# EasyEDA Pro project MyWordEdit.eprj, board PCB1 (continued)
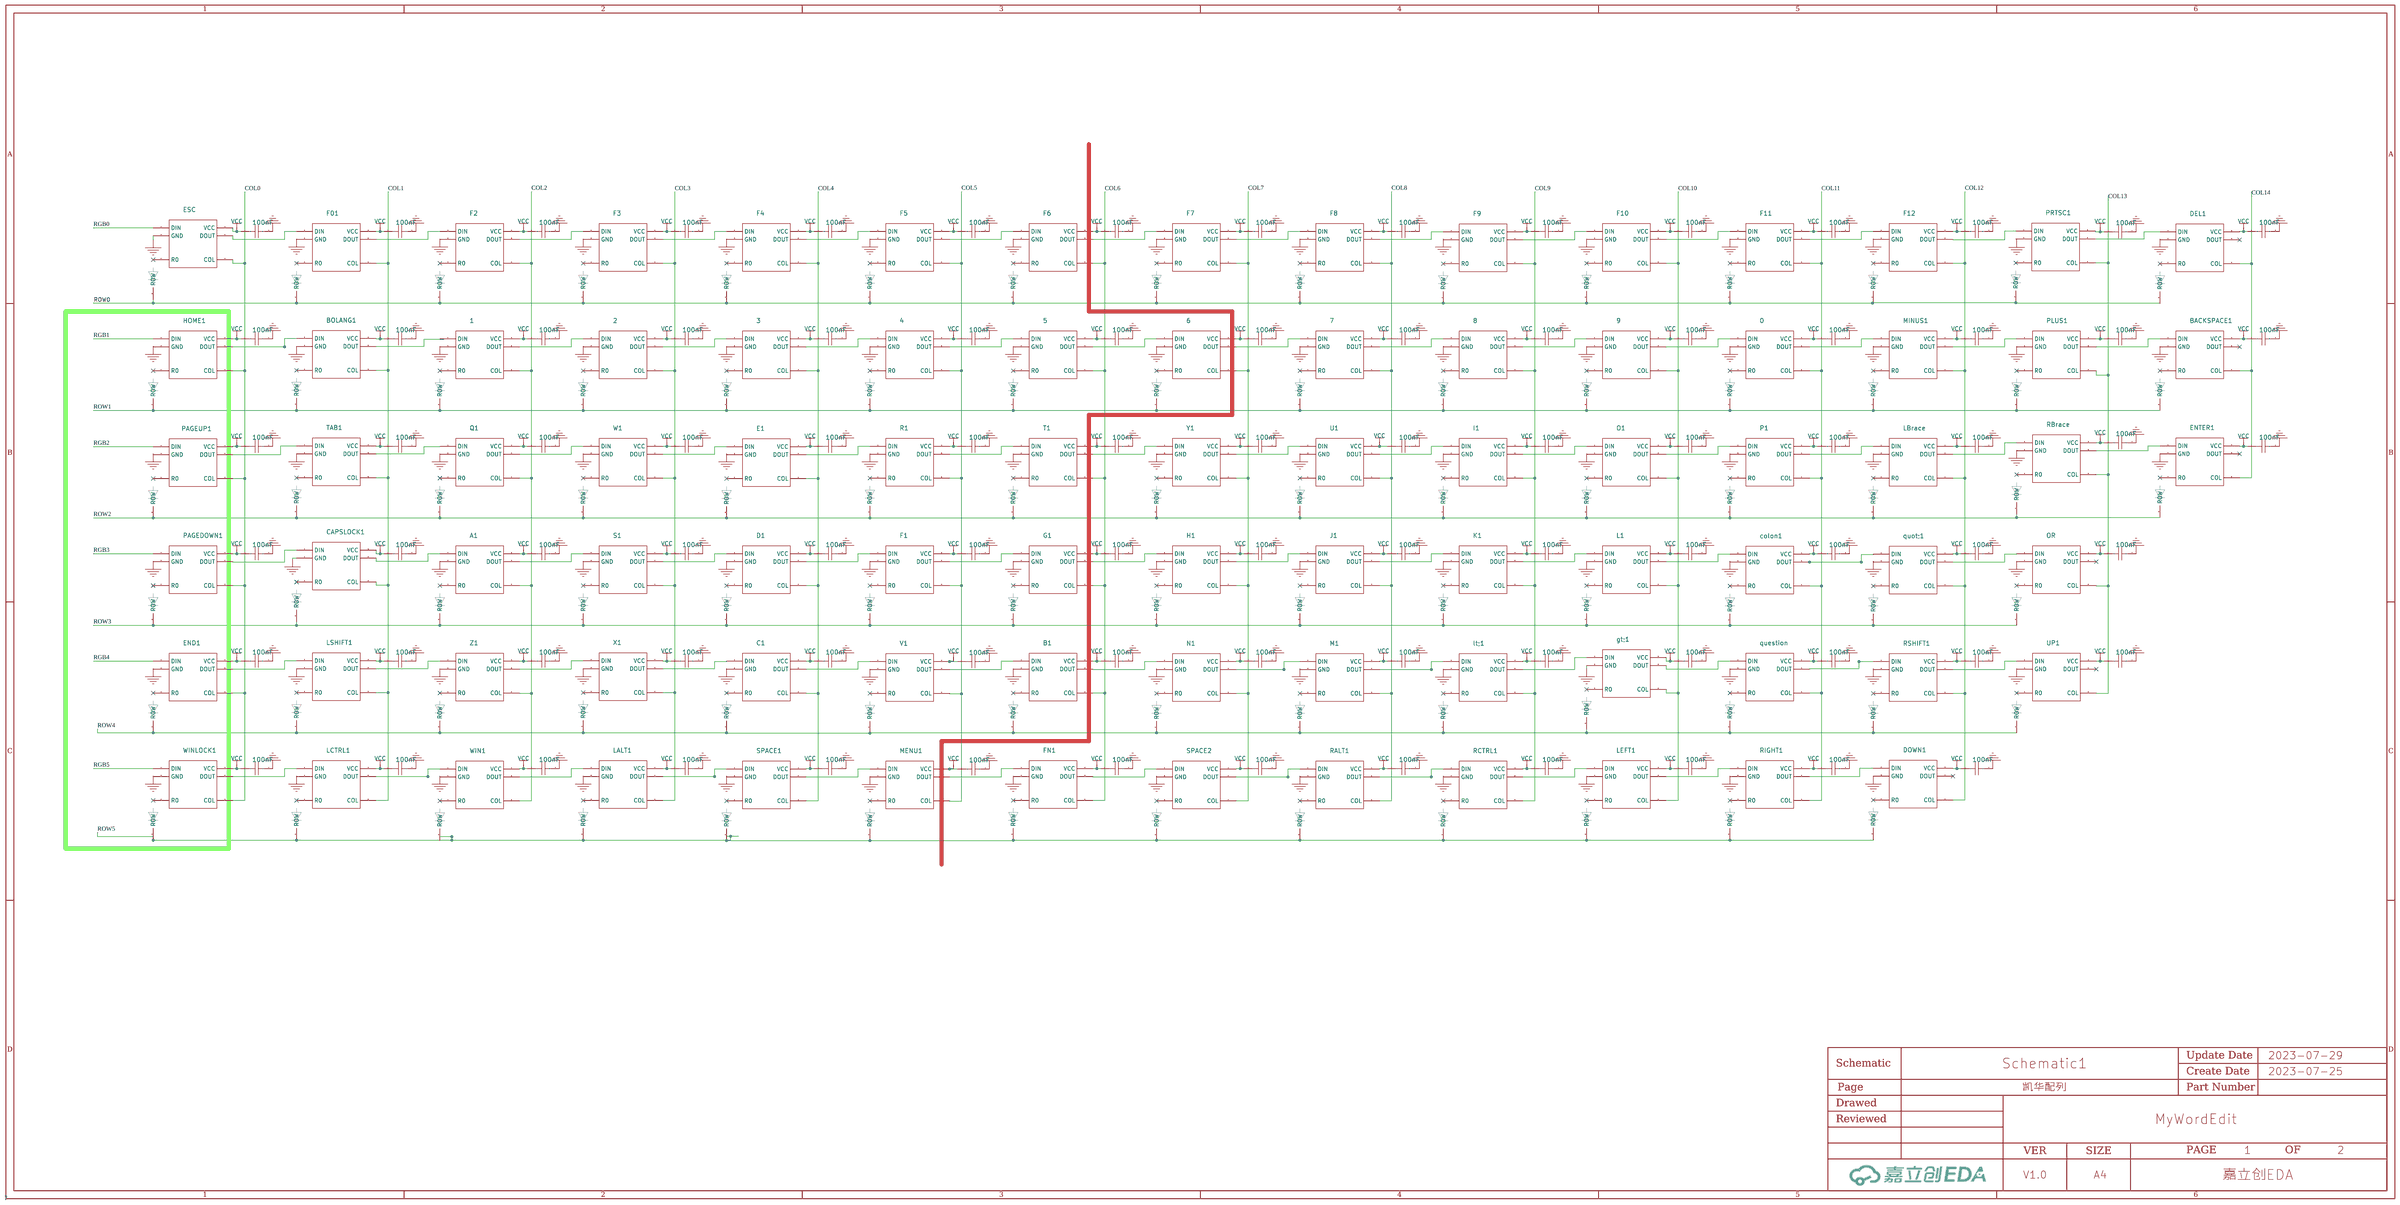
[diagram p0: 凯华配列]
## Routing (per net, layer and track width the routed paths; a pad name or vN(x,y) marks a point on that pad's centre or on a via; arc(x,y) is an arc through that point) (continued)
(no net): length 326.4
  Bottom Layer w0.254: L1.R0 233.64,49.63 L1.R0 ; 107.62,10.99 111.06,10.99 SPACE1.R0 ; colon1.R0 249.51,51.58 colon1.R0 ; 290.72,112.29 290.41,111.98 286.92,111.98 ; F2.R0 74.35,109.8 F2.R0 ; V1.R0 129.34,28.52 125.91,28.52 ; 134.04,65.98 134.39,65.62 T1.R0 ; BACKSPACE1.R0 301.46,93.82 BACKSPACE1.R0 ; F6.R0 150.17,103.19 146.74,103.19 ; ENTER1.R0 311.11,66.01 ENTER1.R0 ; F10.R0 233.39,107.03 F10.R0 ; H1.R0 176.74,44.67 H1.R0 ; OR.R0 290.66,54.58 OR.R0 ; END1.R0 11.61,48.33 11.97,47.97 ; F5.R0 131.25,104.84 F5.R0 ; 242.72,69.82 243.03,70.13 246.52,70.13 ; TAB1.R0 37.78,74.74 TAB1.R0 ; 5.R0 129.6,85.79 5.R0 ; 13.13,105.22 16.57,105.22 HOME1.R0 ; BOLANG1.R0 34.73,94.18 BOLANG1.R0 ; D1.R0 102.55,49.98 102.9,49.62 ; 260.25,33.12 263.74,33.12 question.R0 ; Y1.R0 167.21,63.52 Y1.R0 ; F7.R0 176.49,102.08 F7.R0 ; 1.R0 50.57,92.17 50.22,92.52 ; F01.R0 52.22,111.09 55.66,111.09 ; Q1.R0 58.45,72.36 Q1.R0 ; LALT1.R0 77.91,13.78 LALT1.R0 ; PLUS1.R0 269.83,91.72 PLUS1.R0 ; W1.R0 80.45,71.06 W1.R0 ; 268.12,52.93 268.43,53.23 271.92,53.23 ; RALT1.R0 241.77,12.16 RALT1.R0 ; 290.21,35.71 289.9,35.4 286.41,35.4 ; PAGEDOWN1.R0 13.27,67.25 PAGEDOWN1.R0 ; 2.R0 72.7,90.75 2.R0 ; F4.R0 112.33,106.49 F4.R0 ; 185.83,64.87 186.13,65.17 189.62,65.17 ; 191.92,103.73 195.41,103.73 195.72,104.03 ; 184.43,26.51 184.74,26.82 N1.R0 ; 8.R0 194.01,84.98 8.R0 ; DOWN1.R0 314.4,19.07 DOWN1.R0 ; 226.2,30.12 222.71,30.12 222.4,29.81 ; RCTRL1.R0 260.69,13.81 257.2,13.81 ; 89.84,108.15 93.28,108.15 F3.R0 ; CAPSLOCK1.R0 38.54,55.57 38.9,55.21 ; F1.R0 121.47,48.33 F1.R0 ; WINLOCK1.R0 6.88,29.05 6.53,29.41 ; 178.45,83.33 174.96,83.33 174.65,83.03 ; ESC.R0 36.38,113.1 32.94,113.1 ; F9.R0 211.28,105.69 F9.R0 ; PAGEUP1.R0 14.92,86.3 PAGEUP1.R0 ; 41.94,35.78 41.59,36.14 LSHIFT1.R0 ; LCTRL1.R0 30.41,17.98 30.77,17.62 ; 80.19,51.63 83.62,51.63 S1.R0 ; X1.R0 91.37,31.82 91.73,31.46 ; LBrace.R0 265.26,71.6 LBrace.R0 ; 137.08,46.68 140.52,46.68 G1.R0 ; C1.R0 110.42,30.17 C1.R0 ; UP1.R0 315.94,37.69 312.44,37.69 ; Z1.R0 72.45,33.47 69.01,33.47 ; F11.R0 249.25,108.99 F11.R0 ; FN1.R0 180.05,6.7 176.55,6.7 ; gt;1.R0 241.63,31.77 gt;1.R0 ; M1.R0 206.84,28.16 M1.R0 ; A1.R0 64.57,53.28 A1.R0 ; 192.18,46.32 192.48,46.63 J1.R0 ; 215.02,48.28 211.53,48.28 211.23,47.97 ; MINUS1.R0 250.9,89.94 MINUS1.R0 ; 231.55,87.98 235.04,87.98 235.34,88.29 ; SPACE2.R0 210.91,9.37 SPACE2.R0 ; 3.R0 91.62,89.1 3.R0 ; WIN1.R0 54.16,15.94 50.72,15.94 ; 148.88,83.79 148.52,84.14 6.R0 ; RBrace.R0 284.19,73.25 280.69,73.25 ; 223.8,68.17 227.29,68.17 O1.R0 ; 267.87,110.33 271.36,110.33 F12.R0 ; MENU1.R0 141.92,8.2 MENU1.R0 ; RIGHT1.R0 298.66,17.11 RIGHT1.R0 ; B1.R0 148.27,26.87 B1.R0 ; 9.R0 212.93,86.64 9.R0 ; R1.R0 118.42,67.63 R1.R0 ; 107.11,87.44 110.55,87.44 4.R0 ; DEL1.R0 309.33,113.63 DEL1.R0
AT: length 102.6
  Top Layer w0.254: v1(151.64,56.26) 152.22,55.68 154.07,55.68 156.5,53.24 159.04,53.24 161.54,50.74 v1(161.54,48.51) ; v1(153.67,68.2) 153.67,60.71 151.77,58.8 v1(151.77,57.78) ; v1(162.94,47.12) 162.94,44.7 v1(163.07,44.58) ; v1(163.83,89.79) 163.83,83.31 158.12,77.6 156.15,77.6 153.8,75.25 153.8,71.37 v1(153.67,71.25) ; v1(163.83,92.71) 163.83,103.89 159.34,108.37 v1(159.34,119.13)
  Bottom Layer w0.254: v1(161.54,48.51) v1(162.94,47.12) ; v1(153.67,71.25) v1(153.67,68.2) ; v1(151.77,57.78) 151.64,57.66 v1(151.64,56.26) ; v1(159.34,119.13) BTK-05.26 ; v1(163.07,44.58) 163.07,44.18 162.96,44.07 U6.22 ; v1(163.83,92.71) v1(163.83,89.79)
BOOT0: length 50.2
  Top Layer w0.254: v1(160.02,47.24) 160.02,47.24 160.91,46.35 160.91,38.04 162.56,36.38 162.56,33.91 162.89,33.58 162.89,31.32 162.31,30.73 v1(162.31,18.29) ; v1(162.31,12.32) v1(162.31,16.26)
  Bottom Layer w0.254: v1(162.31,16.26) v1(162.31,18.29) ; U6.60 163.53,54.52 163.53,52.91 162.81,52.2 160.53,52.2 158.32,49.99 158.32,48.95 v1(160.02,47.24) ; R4.1 163.45,11.18 v1(162.31,12.32)
BOOT1: length 32
  Top Layer w0.254: v1(160.78,36.83) 160.77,36.83 159.51,38.08 v1(159.51,41.27) ; v1(161.42,18.41) 161.67,18.67 v1(161.67,20.45) ; v1(161.16,35.18) v1(161.16,32.13)
  Bottom Layer w0.254: v1(160.78,36.83) 161.16,36.45 v1(161.16,35.18) ; v1(161.16,32.13) 161.95,31.34 161.95,20.73 v1(161.67,20.45) ; v1(161.42,18.41) 161.72,18.11 161.72,14.55 162.18,14.1 R3.2 ; v1(159.51,41.27) 159.96,41.72 U6.28
COL0: length 277.3
  Top Layer w0.254: v1(24.13,36.19) 24.13,33.53 v1(23.75,33.15) ; v1(36.83,109.85) 35.94,108.97 v1(34.42,108.97) ; v1(28.7,93.47) 27.44,92.21 v1(27.44,90.81) ; v1(25.91,75.56) v1(25.91,72.83) ; v1(25.78,55.88) 25.78,52.7 v1(25.53,52.45) ; v1(27.05,67.31) 29.46,64.9 29.46,57.28 33.78,52.96 52.71,52.96 55.25,50.42 72.01,50.42 73.53,48.89 89.15,48.89 90.68,47.37 105.67,47.37 107.06,45.97 126.02,45.97 127.97,44.02 154.89,44.02 v1(155.07,44.2)
  Bottom Layer w0.254: U6.33 155.07,44.2 v1(155.07,44.2) ; 23.51,106.69 23.64,106.56 HOME1.COL ; PAGEUP1.COL 22.14,87.48 25.52,87.48 ; PAGEDOWN1.COL 25.78,66.52 v1(25.78,55.88) ; PAGEDOWN1.COL 25.91,70.78 v1(25.91,72.83) ; PAGEDOWN1.COL 25.77,68.59 v1(27.05,67.31) ; PAGEDOWN1.COL 23.59,68.71 PAGEDOWN1.COL ; HOME1.COL 28.7,104.87 v1(28.7,93.47) ; HOME1.COL 29.42,108.97 v1(34.42,108.97) ; WINLOCK1.COL 20.28,30.87 WINLOCK1.COL 21.34,30.74 v1(23.75,33.15) ; v1(25.91,75.56) 25.91,87.09 25.52,87.48 ; 18.56,49.79 19.05,49.3 22.43,49.3 ; v1(27.44,90.81) 27.44,89.71 PAGEUP1.COL 25.52,87.48 ; 22.43,49.3 24.13,47.6 v1(24.13,36.19) ; 22.43,49.3 22.06,49.66 22.74,49.66 v1(25.53,52.45) ; v1(36.83,109.85) 42.25,109.85 ESC.COL 43.45,114.43 ESC.COL
COL1: length 263.6
  Top Layer w0.254: v1(154.43,44.96) 153.85,44.37 145.52,44.37 141.5,48.39 140.25,48.39 136.24,44.37 128.12,44.37 122.62,49.88 121.04,49.88 117.49,46.33 108.89,46.33 103.69,51.53 102.11,51.53 98.31,47.73 90.83,47.73 85.37,53.18 83.19,53.18 81.96,51.94 69.72,51.94 65.66,56.01 53.34,56.01 v1(52.71,55.37) ; v1(54.86,43.94) v1(54.86,42.13) ; v1(48.9,104.39) 48.9,104.3 v1(47.63,103.03) ; v1(49.91,82.8) v1(49.91,80.38) ; v1(51.56,63.75) v1(51.56,61.41) ; v1(47.5,25.78) 47.5,24.38 v1(46.74,23.62)
  Bottom Layer w0.254: BOLANG1.COL 45.18,93.63 49.91,88.9 v1(49.91,82.8) ; BOLANG1.COL 45.05,95.64 BOLANG1.COL ; BOLANG1.COL 47.63,97.96 v1(47.63,103.03) ; 44.72,76.21 48.1,76.21 TAB1.COL ; CAPSLOCK1.COL 48.86,57.03 48.99,56.9 ; LSHIFT1.COL 51.91,37.6 48.53,37.6 ; LSHIFT1.COL 54.86,40.3 v1(54.86,42.13) ; LSHIFT1.COL 52.04,30.32 v1(47.5,25.78) ; v1(48.9,104.39) 52.58,108.08 61.72,108.08 65.75,112.11 65.75,112.78 65.62,112.91 F01.COL ; TAB1.COL 51.56,72.74 v1(51.56,63.75) ; TAB1.COL 49.91,77.77 v1(49.91,80.38) ; v1(46.74,23.62) 42.42,19.31 37.48,19.31 LCTRL1.COL ; 48.99,56.9 51.17,56.9 v1(52.71,55.37) 54.86,53.21 v1(54.86,43.94) ; 48.99,56.9 51.56,59.48 v1(51.56,61.41) ; U6.34 155.12,45.64 v1(154.43,44.96)
COL2: length 247.1
  Top Layer w0.254: v1(153.8,45.59) 152.93,44.73 145.67,44.73 141.65,48.74 140.1,48.74 136.09,44.73 128.27,44.73 122.76,50.23 120.89,50.23 117.34,46.68 109.04,46.68 103.84,51.88 101.97,51.88 98.17,48.08 91.11,48.08 85.66,53.53 83.04,53.53 81.83,52.32 77.34,52.32 v1(77.09,52.58) ; v1(73.28,81.03) v1(73.28,78.11) ; v1(76.2,61.34) 76.2,59.05 v1(76.07,58.93) ; v1(83.69,41.53) v1(83.69,39.12) ; v1(66.04,101.85) v1(66.04,104.27) ; v1(67.95,23.75) v1(67.95,21.84)
  Bottom Layer w0.254: v1(66.04,104.27) 67.95,106.17 79.88,106.17 84.8,111.09 F2.COL 81.42,111.13 81.29,111.26 ; Z1.COL 79.52,34.8 Z1.COL ; Z1.COL 82.9,30.95 80.26,28.32 72.52,28.32 v1(67.95,23.75) ; Z1.COL 83.69,35.6 v1(83.69,39.12) ; v1(76.2,61.34) 76.2,67.94 71.97,72.17 Q1.COL ; A1.COL 77.85,51.79 77.85,47.37 v1(83.69,41.53) ; A1.COL 71.64,54.62 A1.COL ; A1.COL 76.07,55.67 v1(76.07,58.93) ; 60.59,93.99 60.72,93.86 1.COL ; v1(73.28,81.03) 70.99,83.31 70.12,83.31 64.1,89.33 1.COL ; Q1.COL 71.85,74.18 68.47,74.18 ; Q1.COL 73.28,75.35 v1(73.28,78.11) ; 1.COL 66.04,95.8 v1(66.04,101.85) ; v1(153.8,45.59) 154.35,46.14 U6.35 ; WIN1.COL 64.48,17.41 WIN1.COL 67.95,20.62 v1(67.95,21.84)
COL3: length 223.2
  Top Layer w0.254: v1(94.11,50.29) 94.11,50.26 95.93,48.44 98.02,48.44 101.82,52.24 103.99,52.24 104.01,52.2 104.03,52.2 109.19,47.04 117.2,47.04 120.74,50.59 122.91,50.59 128.41,45.08 135.89,45.08 139.95,49.15 141.75,49.15 145.81,45.08 152.15,45.08 v1(153.29,46.23) ; v1(91.95,78.99) v1(91.95,76.73) ; v1(102.87,39.88) v1(102.87,37.34) ; v1(95,59.44) v1(95,57.76) ; v1(85.47,101.98) v1(85.47,99.44) ; v1(91.06,21.72) v1(91.06,19.69)
  Bottom Layer w0.254: 2.COL 85.47,94.4 v1(85.47,99.44) ; 2.COL 83.15,87.43 88.41,82.17 88.77,82.17 v1(91.95,78.99) ; 2.COL 79.77,92.08 2.COL ; v1(91.95,76.73) 91.95,73.45 W1.COL ; S1.COL 90.69,52.97 S1.COL ; S1.COL 95,53.89 v1(95,57.76) ; S1.COL 94.07,48.8 102.87,40 v1(102.87,39.88) ; v1(91.06,21.72) 101.82,32.48 101.82,33.15 ; 84.85,15.25 88.23,15.25 LALT1.COL 91.06,17.82 v1(91.06,19.69) ; 101.82,33.15 101.69,33.28 X1.COL ; 101.82,33.15 102.87,34.2 v1(102.87,37.34) ; U6.36 153.71,46.64 v1(153.29,46.23) ; W1.COL 90.77,72.52 W1.COL ; W1.COL 90.9,69.76 93.47,67.18 95.5,67.18 96.14,66.55 96.14,60.58 v1(95,59.44) ; v1(85.47,101.98) 87.5,104.01 98.81,104.01 103.72,108.93 F3.COL 103.6,109.61 F3.COL
COL4: length 198.3
  Top Layer w0.254: v1(122.43,38.1) v1(122.43,35.47) ; v1(152.78,46.86) 151.36,45.44 146.07,45.44 142,49.5 139.81,49.5 135.74,45.44 128.56,45.44 123.06,50.94 120.54,50.94 118.42,48.82 116.15,48.82 v1(114.94,50.04) ; v1(104.78,101.85) 104.78,99.57 v1(104.52,99.31) ; v1(124.33,19.18) v1(124.33,16.76) ; v1(111,75.45) v1(111,77.09) ; v1(114.17,57.91) v1(114.17,55.8)
  Bottom Layer w0.254: v1(111,77.09) 111,77.1 103.89,84.22 103.89,88.62 3.COL 102.48,90.83 ; C1.COL 117.49,31.5 C1.COL ; C1.COL 122.43,33.06 v1(122.43,35.47) ; C1.COL 120.87,30.02 124.33,26.56 v1(124.33,19.18) ; v1(152.78,46.86) 153.06,47.14 U6.37 ; v1(114.17,57.91) 114.17,64.64 109.88,68.94 E1.COL ; E1.COL 111,71.84 v1(111,75.45) ; E1.COL 109.75,70.85 E1.COL ; v1(114.17,55.8) 114.17,52.49 113,51.31 ; 102.48,90.83 98.84,90.83 3.COL ; 102.48,90.83 104.52,92.88 v1(104.52,99.31) ; SPACE1.COL 121.38,12.45 SPACE1.COL 124.33,15.15 v1(124.33,16.76) ; 113,51.31 113.66,51.31 v1(114.94,50.04) ; 113,51.31 113,46.77 118.24,41.53 119,41.53 v1(122.43,38.1) ; 113,51.31 112.87,51.44 D1.COL ; F4.COL 122.65,107.96 F4.COL 117.81,102.87 105.79,102.87 v1(104.78,101.85)
COL5: length 181.3
  Top Layer w0.254: v1(123.06,100.08) v1(123.06,97.22) ; v1(129.92,75.44) v1(129.92,73.41) ; v1(140.84,34.29) v1(140.84,36.58) ; v1(132.84,56.39) v1(132.84,54.36) 138.68,54.36 v1(138.68,54.36) ; v1(152.78,47.75) 152.78,48.66 149.37,52.07 148.84,52.07 148.43,52.48 147.67,52.48 147.19,52.96 v1(146.18,52.96) ; v1(154.18,13.97) v1(154.18,16.51)
  Bottom Layer w0.254: v1(152.78,47.75) 152.89,47.64 U6.38 ; v1(132.84,54.36) 132.84,50.59 F1.COL ; 4.COL 121,86.9 125.35,82.55 125.35,80.26 127.37,78.23 128.4,78.23 129.92,76.71 v1(129.92,75.44) ; 4.COL 123.06,90.85 v1(123.06,97.22) ; 4.COL 120.87,88.91 117.49,88.91 ; v1(129.92,73.41) 129.92,70.02 R1.COL ; 152.49,9.66 154.18,11.34 v1(154.18,13.97) ; 152.49,9.66 MENU1.COL ; 152.49,9.66 148.86,9.66 ; 139.92,29.98 140.84,30.9 v1(140.84,34.29) ; 139.92,29.98 V1.COL 139.79,27.47 142.46,24.8 146.9,24.8 154.18,17.53 v1(154.18,16.51) ; 139.92,29.98 136.28,29.98 ; 125.36,69.1 128.74,69.1 R1.COL ; F1.COL 131.92,44.99 137.03,39.88 137.54,39.88 v1(140.84,36.58) ; F1.COL 131.79,49.79 128.41,49.79 ; v1(132.84,56.39) 132.84,63.51 128.87,67.48 R1.COL ; v1(123.06,100.08) 124.21,101.22 137.16,101.22 141.7,105.76 F5.COL 141.57,106.31 F5.COL ; v1(138.68,54.36) 139.45,53.59 145.54,53.59 v1(146.18,52.96)
COL6: length 189.2
  Top Layer w0.254: v1(149.35,71.37) 149.35,70.36 v1(148.59,69.6) ; v1(160.27,11.05) v1(160.27,8.5) ; v1(160.53,36.07) 160.53,32.51 v1(160.15,32.13) ; v1(151.89,64.13) 152.4,63.63 v1(152.4,60.96) ; v1(141.48,95.12) 142.37,96.01 v1(142.37,97.15)
  Bottom Layer w0.254: B1.COL 158.59,28.33 158.72,28.2 159.15,28.63 ; v1(160.15,32.13) 160.15,29.63 159.15,28.63 ; v1(160.53,36.07) 160.53,36.26 159.78,37.01 158.76,37.01 158.18,37.59 156.59,37.59 150.97,43.21 G1.COL 151.17,48.21 ; FN1.COL 189.51,9.94 FN1.COL 190,6.35 187.07,3.43 165.34,3.43 v1(160.27,8.5) ; 159.15,28.63 159.15,12.18 v1(160.27,11.05) ; T1.COL 144.54,67.32 T1.COL ; T1.COL 147.92,68.93 v1(148.59,69.6) ; T1.COL 148.71,67.32 v1(151.89,64.13) ; v1(142.37,97.15) 145.42,100.2 156.3,100.2 F6.COL 157.24,104.53 157.11,104.66 ; v1(149.35,71.37) 149.35,74.04 146.18,77.22 145.16,77.22 141.86,80.52 141.86,85.32 5.COL ; 5.COL 139.92,87.26 5.COL ; 152.4,49.44 v1(152.4,60.96) ; 152.4,49.44 151.17,48.21 ; 152.4,49.44 152.4,49.02 153.28,48.14 U6.39 ; 5.COL 141.48,88.56 v1(141.48,95.12) ; 151.17,48.21 147.53,48.21 G1.COL
COL7: length 220
  Top Layer w0.254: v1(180.47,72.39) v1(180.47,70.1) ; v1(161.29,95.5) v1(161.29,93.47) ; v1(187.45,51.56) v1(187.45,53.85) ; v1(220.98,19.43) 221.11,19.3 v1(221.11,17.14) ; v1(198.12,36.19) v1(198.12,33.4) ; v1(155.83,56.01) 156.41,56.59 169.43,56.59 170.62,57.78 v1(171.58,57.78)
  Bottom Layer w0.254: Y1.COL 187.45,59.83 v1(187.45,53.85) ; Y1.COL 179.86,66.46 Y1.COL ; Y1.COL 180.34,66.58 178.28,64.52 176.02,64.52 174.37,62.86 v1(174.37,57.66) 174.24,57.78 v1(171.58,57.78) ; Y1.COL 180.34,69.98 v1(180.47,70.1) ; F7.COL 185.96,105.32 ; 185.96,105.32 180.33,99.69 177.42,99.69 175.13,97.41 163.2,97.41 v1(161.29,95.5) ; 185.96,105.32 182.96,105.32 ; H1.COL 187.45,49.16 v1(187.45,51.56) ; H1.COL 186.21,47.92 183.22,47.92 ; H1.COL 188.11,46.98 188.11,42.96 191.07,40 192.66,40 193.29,39.37 195.33,39.37 198.12,36.58 v1(198.12,36.19) ; 6.COL 161.29,87.8 v1(161.29,93.47) ; 6.COL 158.84,85.61 6.COL ; 6.COL 168.25,76.2 176.66,76.2 v1(180.47,72.39) ; v1(198.12,33.4) 198.12,30.49 N1.COL ; N1.COL 204.99,23.11 216.03,23.11 217.42,21.72 218.69,21.72 v1(220.98,19.43) ; N1.COL 197.39,29.75 N1.COL ; SPACE2.COL 220.38,12.61 SPACE2.COL 220.86,16.9 v1(221.11,17.14) ; U6.40 153.54,48.64 153.04,49.15 v1(153.04,49.28) 152.76,49.56 152.76,54.71 153.72,55.68 155.5,55.68 v1(155.83,56.01)
COL8: length 217.2
  Top Layer w0.254: v1(217.04,34.8) 217.04,37.89 v1(217.11,37.96) ; v1(162.05,41.91) 162.1,41.96 177.22,41.96 179.98,44.73 196.76,44.73 199.66,47.62 203.2,47.62 203.84,48.26 v1(205.36,48.26) ; v1(188.6,94.87) v1(188.6,97.28) ; v1(206.12,52.7) v1(206.12,55.37) ; v1(252.1,21.46) v1(252.1,19.04) ; v1(199.39,73.91) v1(199.39,71.88)
  Bottom Layer w0.254: U1.COL 198.79,68.11 U1.COL ; 205.36,49.79 J1.COL ; 205.36,49.79 v1(205.36,48.26) ; 205.36,49.79 205.14,49.57 J1.COL ; J1.COL 208.53,47.13 208.53,45.34 212.85,41.02 214.05,41.02 v1(217.11,37.96) ; J1.COL 206.12,50.55 v1(206.12,52.7) ; M1.COL 217.04,32.14 v1(217.04,34.8) ; M1.COL 216.31,31.41 M1.COL ; M1.COL 222.44,26.24 246.18,26.24 247.02,25.4 248.16,25.4 v1(252.1,21.46) ; v1(199.39,73.91) 188.09,85.21 7.COL ; v1(188.6,97.28) 193.04,101.73 200.91,101.73 205.36,106.18 F8.COL 202.37,107.45 F8.COL ; U6.24 161.96,42 v1(162.05,41.91) ; v1(206.12,55.37) 202.69,58.8 202.18,58.8 199.27,61.72 U1.COL ; 248.24,15.4 248.73,15.89 RALT1.COL 252.1,16.26 v1(252.1,19.04) ; 7.COL 188.6,87.26 v1(188.6,94.87) ; 7.COL 187.61,86.27 7.COL ; U1.COL 199.39,68.71 v1(199.39,71.88)
COL9: length 241.4
  Top Layer w0.254: v1(207.26,96.27) 207.26,98.3 v1(207.65,98.68) ; v1(218.19,75.44) v1(218.19,73.35) ; v1(236.03,38.84) v1(236.03,36.69) ; v1(224.92,54.23) v1(224.92,57.28) ; v1(271.02,20.57) v1(271.02,22.73) ; v1(224.03,49.15) 219.33,49.15 216.41,46.23 198.88,46.23 196.85,44.2 180.21,44.2 177.34,41.33 161.59,41.33 v1(161.54,41.27)
  Bottom Layer w0.254: K1.COL 224.19,51.22 K1.COL ; v1(207.65,98.68) 212.34,103.38 220.73,103.38 224.41,107.07 F9.COL 223.93,108.62 F9.COL ; lt;1.COL 236.35,33.04 236.35,31.11 238.76,28.7 251.97,28.7 252.4,28.27 256.87,28.27 257.33,28.73 265.41,28.73 266.07,28.07 266.07,27.43 266.57,26.92 267.52,26.92 271.02,23.42 v1(271.02,22.73) ; lt;1.COL 236.03,33.73 v1(236.03,36.69) ; lt;1.COL 235.36,33.06 lt;1.COL ; 224.67,50.21 224.67,49.79 v1(224.03,49.15) ; 224.67,50.21 v1(236.03,38.84) ; 224.67,50.21 K1.COL ; I1.COL 218.19,73.34 v1(218.19,73.35) ; I1.COL 219.33,69.1 219.33,65.79 223.65,65.79 224.92,64.52 v1(224.92,57.28) ; I1.COL 217.71,69.76 214.71,69.76 ; 8.COL 207.14,86.23 214.38,78.99 215.52,78.99 218.19,76.33 v1(218.19,75.44) ; 8.COL 207.14,96.14 v1(207.26,96.27) ; 8.COL 206.66,87.92 8.COL ; RCTRL1.COL 270.16,17.05 RCTRL1.COL 271.02,17.91 v1(271.02,20.57) ; v1(161.54,41.27) 161.46,41.36 U6.25 ; K1.COL 224.92,51.95 v1(224.92,54.23)
COL10: length 257.6
  Top Layer w0.254: v1(226.44,97.66) v1(226.44,99.44) ; v1(173.36,59.44) 174.94,59.44 175.45,59.94 180.53,59.94 182.08,61.49 198.03,61.49 199.88,63.35 218.93,63.35 220.38,64.8 233.07,64.8 237.23,68.96 v1(237.24,68.96) ; v1(289.81,22.48) 289.94,22.61 v1(289.94,24.76) ; v1(237.74,76.71) v1(237.74,74.97) ; v1(170.43,59.44) 168.53,57.53 v1(160.27,57.53) ; v1(254.89,40.77) v1(254.89,38.59) ; v1(243.71,58.8) v1(243.71,56.26)
  Bottom Layer w0.254: v1(237.74,74.97) 237.74,72.4 O1.COL ; v1(289.94,24.76) 286.26,28.45 285.62,28.45 284.48,29.59 258.45,29.59 254.77,33.27 gt;1.COL ; v1(243.71,56.26) 243.71,53.72 ; 243.71,53.72 243.71,53.47 L1.COL 243.59,51.53 251.18,43.94 251.71,43.94 v1(254.89,40.77) ; 243.71,53.72 242.86,52.87 L1.COL ; LEFT1.COL 289.21,18.71 LEFT1.COL 289.81,19.31 v1(289.81,22.48) ; gt;1.COL 254.28,34.71 251.29,34.71 ; gt;1.COL 254.77,38.47 v1(254.89,38.59) ; v1(226.44,97.66) 226.44,90.43 9.COL ; F10.COL 240.34,110.76 F10.COL 243.34,107.57 240.79,105.03 240.54,105.03 238.51,103 230,103 v1(226.44,99.44) ; O1.COL 236.76,71.41 O1.COL ; O1.COL v1(237.24,68.96) 238.63,67.56 242.57,67.56 243.71,66.42 v1(243.71,58.8) ; U6.51 158.96,55.46 160.27,56.77 v1(160.27,57.53) ; v1(237.74,76.71) 237.74,77.34 234.19,80.9 232.79,80.9 226.06,87.63 9.COL ; 9.COL 225.58,89.57 222.59,89.57 ; v1(170.43,59.44) v1(173.36,59.44)
COL11: length 275.6
  Top Layer w0.254: v1(175.13,57.66) 175.13,56.01 v1(171.83,52.7) ; v1(256.16,71.37) 255.02,70.23 249.94,70.23 245.92,66.22 240.01,66.22 238.23,64.44 220.53,64.44 219.08,62.99 200.03,62.99 198.18,61.14 182.23,61.14 180.4,59.31 v1(175.64,59.31) ; v1(274.45,41.91) v1(274.45,39.88) ; v1(262.76,60.07) v1(262.76,58.04) ; v1(256.54,78.61) v1(256.54,76.83) ; v1(245.24,101.98) v1(245.24,99.31) ; v1(308.86,25.65) v1(308.86,24.26)
  Bottom Layer w0.254: v1(262.76,60.07) 262.76,67.94 262,68.71 257.56,68.71 256.16,70.1 256.16,71.37 ; v1(256.16,71.37) 256.16,71.37 ; 256.16,71.37 P1.COL ; 0.COL 245.24,91.95 v1(245.24,99.31) ; 0.COL 244.99,87.37 249.81,82.55 252.6,82.55 v1(256.54,78.61) ; 0.COL 244.51,91.22 0.COL ; v1(274.45,41.91) 270.26,46.1 268.73,46.1 265.43,49.4 265.43,52.21 colon1.COL ; colon1.COL 262.76,55.12 v1(262.76,58.04) ; colon1.COL 262.16,54.52 259.17,54.52 ; v1(245.24,101.98) 249.81,106.55 254.38,106.55 254.64,106.81 260.86,106.81 262.39,108.34 F11.COL 259.39,112.41 258.91,111.92 ; question.COL 277.51,33.02 290.7,33.02 292.1,31.62 302.9,31.62 304.55,29.97 305.94,29.97 308.86,27.05 v1(308.86,25.65) ; question.COL 270.7,36.84 question.COL ; question.COL 274.45,37.6 v1(274.45,39.88) ; v1(171.83,52.7) 171.58,52.45 170.56,52.45 169.67,51.56 169.67,49.4 169.42,49.14 U6.8 ; v1(308.86,24.26) 308.86,21.09 RIGHT1.COL 305.62,20.84 RIGHT1.COL ; P1.COL 253.17,73.54 P1.COL ; P1.COL 256.54,73.92 v1(256.54,76.83) ; v1(175.64,59.31) 175.13,58.8 v1(175.13,57.66)
COL12: length 296
  Top Layer w0.254: v1(275.59,73.02) 270.33,67.77 259.03,67.77 257.12,65.86 240.23,65.86 238.46,64.08 220.68,64.08 219.2,62.61 200.15,62.61 198.32,60.78 182.7,60.78 v1(181.36,59.44) ; v1(264.8,102.74) 264.8,101.22 v1(264.67,101.09) ; v1(281.69,59.44) v1(281.69,61.71) ; v1(275.21,78.49) v1(275.21,80.52) ; v1(300.74,42.54) v1(300.74,44.32) ; v1(179.83,56.9) 176.97,56.9 171.89,51.82 v1(171.45,51.82)
  Bottom Layer w0.254: DOWN1.COL 327.54,22.72 ; 327.54,22.72 326.83,22.01 324.06,22.01 ; 327.54,22.72 327.54,26.67 322.71,31.5 321.44,31.5 320.93,30.99 317.86,30.99 317.15,31.7 312.98,31.7 305.55,39.13 RSHIFT1.COL ; F12.COL 278.32,114.06 F12.COL 281.31,110.24 279.53,108.46 270.51,108.46 v1(264.8,102.74) ; v1(181.36,59.44) 181.36,58.42 v1(179.83,56.9) ; quot;1.COL 281.08,56.17 quot;1.COL ; quot;1.COL 281.69,56.78 v1(281.69,59.44) ; quot;1.COL 285.89,52.32 299.21,52.32 300.74,50.8 v1(300.74,44.32) ; RSHIFT1.COL 296.86,39.13 RSHIFT1.COL ; v1(275.21,78.49) 275.21,75.33 LBrace.COL ; MINUS1.COL 263.56,92.87 MINUS1.COL ; LBrace.COL 274.73,74.84 271.74,74.84 ; LBrace.COL 275.59,74.95 v1(275.59,73.02) ; LBrace.COL 281.56,68.98 281.56,61.84 v1(281.69,61.71) ; v1(171.45,51.82) 170.47,51.82 170.05,51.4 170.05,49.28 169.49,48.71 168.27,48.71 168.21,48.64 U6.9 ; RSHIFT1.COL 300.74,40.01 v1(300.74,42.54) ; MINUS1.COL 268.24,89.15 273.3,89.15 275.21,87.25 v1(275.21,80.52) ; MINUS1.COL 264.67,93.99 v1(264.67,101.09)
COL13: length 309.3
  Top Layer w0.254: v1(294.13,79.63) v1(294.13,82.04) ; v1(285.37,105.28) v1(285.37,102.36)
  Bottom Layer w0.254: PLUS1.COL 290.95,95.13 294.13,91.95 v1(294.13,82.04) ; PLUS1.COL 282.48,94.65 279.49,94.65 ; PLUS1.COL 285.37,97.54 v1(285.37,102.36) ; OR.COL 300.61,56.77 298.7,54.86 295.28,54.86 292.74,57.4 287.02,57.4 285.6,58.83 284.2,58.83 282.42,60.6 277.52,60.6 276.67,59.76 276.67,57.7 276.42,57.45 276.42,57.09 274.7,55.37 271.14,55.37 270.38,54.61 267.84,54.61 267.46,54.99 267.46,56.39 266.45,57.4 264.54,57.4 262.99,58.95 258.85,58.95 257.81,57.91 257.81,56.01 257.18,55.37 257.18,55.12 256.16,54.1 249.94,54.1 248.03,56.01 245.87,56.01 244.58,57.3 239.42,57.3 238.55,56.43 238.55,54.02 237.87,53.34 237.87,52.96 237.49,52.58 230.25,52.58 229.11,53.72 227.46,53.72 225.53,55.65 220.58,55.65 219.62,54.7 219.62,52.44 218.2,51.02 211.49,51.02 209.93,52.58 208.82,52.58 207.4,54 201.7,54 200.79,53.09 200.79,51.18 200.47,50.87 200.47,50.49 199.26,49.28 192.28,49.28 190.88,50.67 189.8,50.67 188.28,52.2 183.13,52.2 181.86,50.93 181.86,49.28 180.09,47.5 175.26,47.5 174.41,48.35 168.41,48.35 168.19,48.13 167.42,48.13 U6.10 ; OR.COL 323.71,58.3 326.77,55.24 326.77,42.3 UP1.COL 325.4,40.93 UP1.COL ; OR.COL 300.13,57.82 OR.COL ; OR.COL 300.61,71.88 295.52,76.97 RBrace.COL ; PRTSC1.COL 299.88,115.23 PRTSC1.COL 300.36,110.62 297.56,107.82 287.91,107.82 v1(285.37,105.28) ; RBrace.COL 293.65,76.49 RBrace.COL ; RBrace.COL 294.14,79.62 v1(294.13,79.63)
COL14: length 244.4
  Top Layer w0.254: v1(321.06,66.55) 309.25,54.74 301.5,54.74 297.69,50.93 255.27,50.93 252.98,48.64 244.98,48.64 243.33,46.99 218.31,46.99 216.92,45.59 198.88,45.59 197.1,43.81 180.47,43.81 177.04,40.39 v1(167.77,40.39)
  Bottom Layer w0.254: BACKSPACE1.COL 308.42,97.55 BACKSPACE1.COL ; BACKSPACE1.COL 311.41,98.81 319.28,106.68 DEL1.COL 318.8,116.88 DEL1.COL ; BACKSPACE1.COL 321.06,87.9 321.06,70.15 ; v1(167.77,40.39) 167.77,40.77 168.5,41.5 168.5,42.71 170.76,44.97 170.76,46.27 169.39,47.64 U6.11 ; v1(321.06,66.55) 321.06,69.73 ENTER1.COL 321.06,70.15 ; 321.06,70.15 320.16,69.25 317.58,69.25
D1+: length 24.5
  Top Layer w0.254: v1(73.79,127.76) 73.56,127.53 67.8,127.53 67.14,126.87 63.93,126.87 62.53,128.27 58.42,128.27 v1(57.53,129.16)
  Bottom Layer w0.254: v1(73.79,127.76) 75.7,125.85 USB1.A6 ; R10.2 R11.2
D1-: length 35.5
  Bottom Layer w0.254: USB1.A7 76.2,129.1 74.16,131.14 73.67,131.14 73.09,130.56 71.35,130.56 70.75,129.95 70.75,129.04 70.17,128.46 62.16,128.46 61.79,128.84 61.79,129.25 61.08,129.95 55.6,129.95 54.41,131.14 51.97,131.14 R12.2
D2+: length 48.4
  Top Layer w0.254: v1(38.61,127.89) 44.13,127.89 44.39,127.63 44.77,127.63 45.02,127.89 57.79,127.89 58.13,127.56 62.21,127.56 63.25,126.52 63.28,126.52 63.63,126.16 67.43,126.16 68.09,126.82 73.08,126.82 74.17,125.73 74.17,123.06 74.63,122.61 76.25,122.61 76.71,123.06 v1(76.71,123.32)
  Bottom Layer w0.254: USB1.B6 76.71,124.45 v1(76.71,123.32) ; v1(38.61,127.89) 38.61,128.88 R20.2 ; R19.2 R20.2 ; R20.2 37.75,129.09
D2-: length 34.2
  Top Layer w0.254: v1(44.58,128.27) 57.92,128.27 58.27,127.91 62.36,127.91 63.4,126.87 63.42,126.87 63.78,126.52 67.28,126.52 67.94,127.18 73.36,127.18 v1(74.93,125.6)
  Bottom Layer w0.254: R21.2 44.58,129.01 v1(44.58,128.27) ; v1(74.93,125.6) 75.2,125.34 USB1.B7
I2C1_SCL: length 4.9
  Bottom Layer w0.254: U6.58 162.46,56.27 R8.2
I2C1_SDA: length 12.3
  Top Layer w0.254: v1(156.85,56.01) v1(163.45,56.01)
  Bottom Layer w0.254: v1(163.45,56.01) 162.96,55.52 U6.59 ; R14.2 153.92,58.51 153.92,58.44 155.47,56.9 155.83,56.9 156.72,56.01 v1(156.85,56.01)
NRST: length 39
  Top Layer w0.254: v1(164.21,32) 163.4,32.82 163.4,39.19 v1(164.59,40.39)
  Bottom Layer w0.254: S2.1 167.77,18.8 166.75,19.81 R5.1 166.75,24 C8.1 165.1,31.11 v1(164.21,32) ; U6.7 165.91,49.64 165.66,49.39 165.66,44.29 166.83,43.12 166.83,42.11 165.1,40.39 v1(164.59,40.39)
RGB0: length 259.7
  Top Layer w0.254: v1(45.47,122.55) 45.85,122.17 v1(45.85,120.78) ; v1(45.85,119) 43.94,119 43.05,118.11 43.05,117.35 41.78,116.08 41.78,115.82 40.77,114.81 29.85,114.81 v1(29.59,115.06) 29.59,115.19 28.19,116.59 15.75,116.59 9.4,110.24 9.4,65.91 10.32,64.99 27.43,64.99 29.11,63.31 29.11,57.13 33.66,52.58 52.58,52.58 55.09,50.06 71.73,50.06 73.25,48.54 88.88,48.54 90.42,46.99 105.41,46.99 106.81,45.59 125.86,45.59 127.84,43.61 159.44,43.61 160.02,44.2 v1(160.02,45.08)